# EasyEDA Pro project FPGA-G1.eprj, board logi Pi
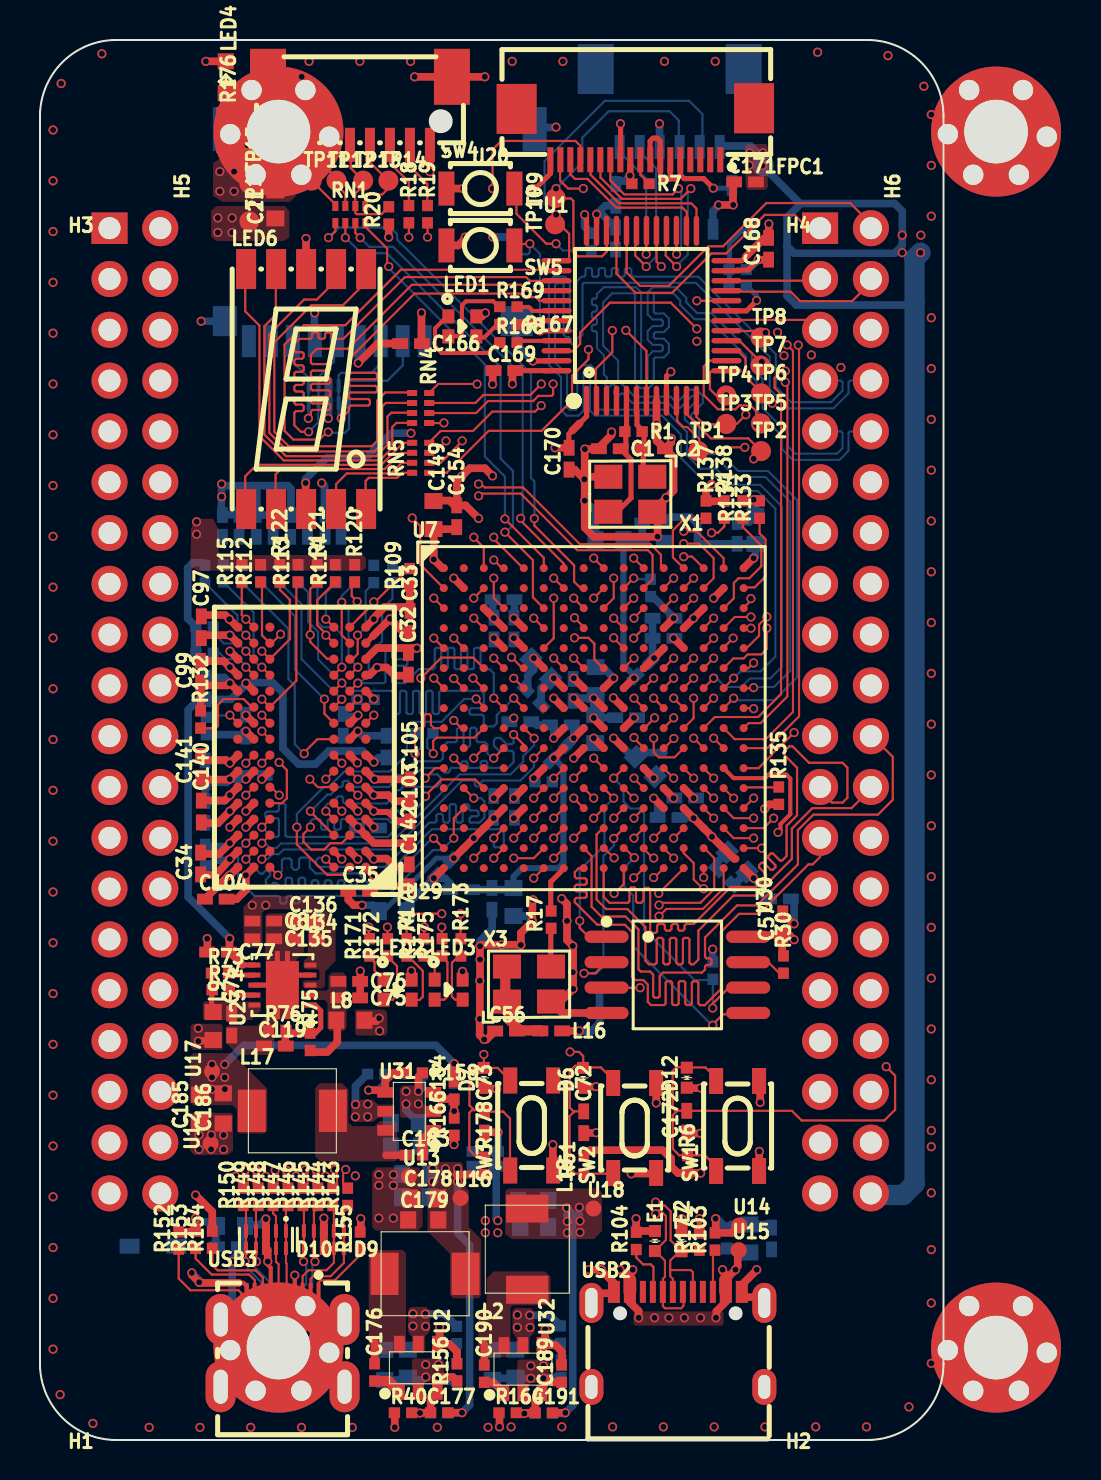
[diagram p10: board, top side]
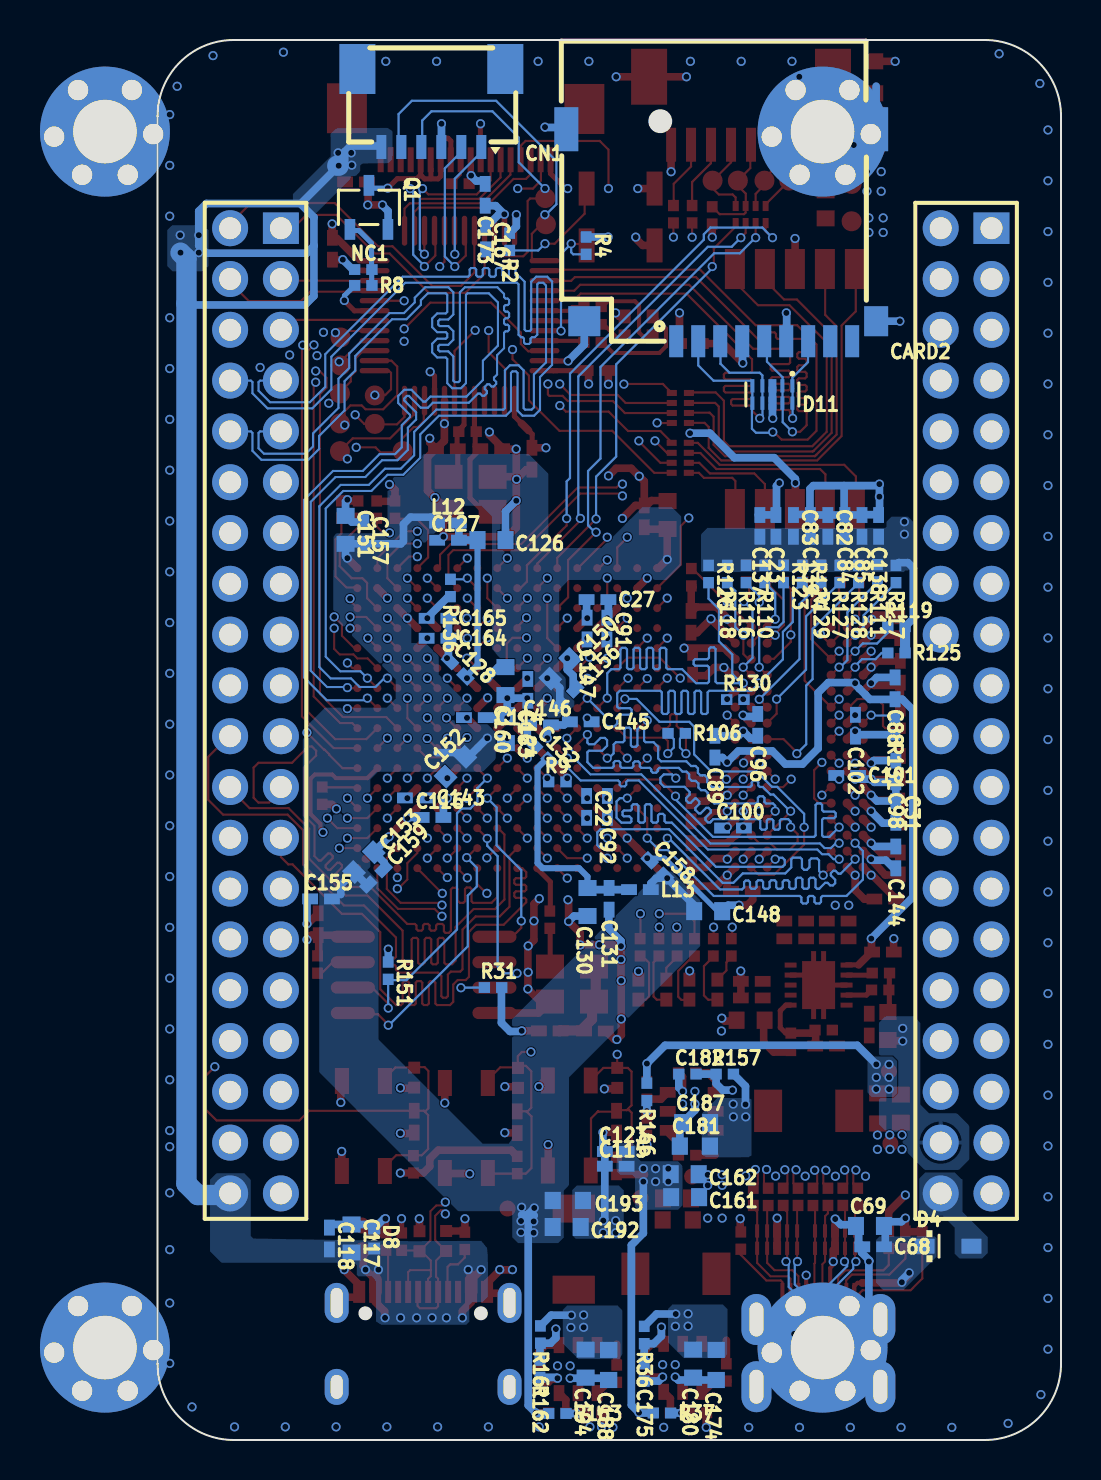
[diagram p11: board, bottom side, seen from below]

Outline 45.2 x 70 mm; copper layers: Top Layer, GND02, SIG03, SIG04, POWER05, Bottom Layer. Coordinates in mm from the lower left corner of the outline.
Outline path: 0,66.19 arc(1.12,68.88) 3.81,70 41.39,70 arc(44.08,68.88) 45.2,66.19 45.2,3.81 arc(44.08,1.12) 41.39,0 3.81,0 arc(1.12,1.12) 0,3.81 0,66.19
Stack: Top Layer 0.035mm 外层铜厚1oz / Dielectric1 0.0994mm 3313 RC57% 4.2mil / GND02 0.0152mm 内层铜厚 / Dielectric2 0.55mm 0.55mm H/H No copper / SIG03 0.0152mm 内层铜厚 / Dielectric3 0.1088mm 2116 RC54% 4.9mil / SIG04 0.0152mm 内层铜厚 / Dielectric4 0.55mm 0.55mm H/H No copper / POWER05 0.0152mm 内层铜厚 / Dielectric5 0.0994mm 3313 RC57% 4.2mil / Bottom Layer 0.035mm 外层铜厚1oz

## Design rules (mm)
net GND: POWER
net +5V_IN: POWER
net +3.3V: POWER
net VTT_DRAM: POWER
net +1.5V: POWER
net HDMI_5V: POWER
net VREF_DRAM: POWER
net VCCPLLL: POWER
net VCCPLLR: POWER
net +1.0V: POWER
net PB4/SPI2_MISO: TF CARD
net PB3/SPI2_SCK: TF CARD
net PB5/SPI2_MOSI: TF CARD
net PA15/SPI2_NSS: TF CARD
net HDMI_DATA2_P: HDMI_DATA2_
net HDMI_DATA2_N: HDMI_DATA2_
net HDMI_DATA1_P: HDMI_DATA1_
net HDMI_DATA1_N: HDMI_DATA1_
net HDMI_DATA0_P: HDMI_DATA0_
net HDMI_DATA0_N: HDMI_DATA0_
net HDMI_CLK_P: HDMI_CLK_
net HDMI_CLK_N: HDMI_CLK_
net M15_IOT40B: USB
net M14_IOT40A: USB
net EX_IOT24B_K16: BANK0, FPGA_IOT24
net EX_IOT24A_J15: BANK0, FPGA_IOT24
net EX_IOT22B_J14: BANK0, FPGA_IOT22
net EX_IOT22A_J16: BANK0, FPGA_IOT22
net EX_IOT9A_F14: BANK0, FPGA_IOT9
net EX_IOT9B_F16: BANK0, FPGA_IOT9
net EX_IOT27B_J13: BANK0, FPGA_IOT27
net EX_IOT27A_H11: BANK0, FPGA_IOT27
net EX_IOT6A_E16: BANK0, FPGA_IOT6
net EX_IOT6B_F15: BANK0, FPGA_IOT6
net EX_IOT5A_C16: BANK0, FPGA_IOT5
net EX_IOT5B_D15: BANK0, FPGA_IOT5
net EX_IOT4A_D16: BANK0, FPGA_IOT4
net EX_IOT4B_E14: BANK0, FPGA_IOT4
net EX_IOL8A_B13: BANK7, FPGA_IOL8
net EX_IOL8B_A14: BANK7, FPGA_IOL8
net EX_IOL2A_B14: BANK7, FPGA_IOT2
net EX_IOL2B_A15: BANK7, FPGA_IOT2
net EX_IOL13B_A12: BANK7, FPGA_IOL13
net EX_IOL13A_B11: BANK7, FPGA_IOL13
net EX_IOL7B_B12: BANK7, FPGA_IOL7
net EX_IOL7A_C12: BANK7, FPGA_IOL7
net EX_IOL15B_C11: BANK7, FPGA_IOL15
net EX_IOL15A_A11: BANK7, FPGA_IOL15
net EX_IOL27B_C9: BANK7, FPGA_IOL27
net EX_IOL27A_A9: BANK7, FPGA_IOL27
net EX_IOL17B_E10: BANK7, FPGA_IOL17
net EX_IOL17A_D10: BANK7, FPGA_IOL17
net EX_IOR27A_N10: BANK2, FPGA_IOR27
net EX_IOR27B_M11: BANK2, FPGA_IOR27
net EX_IOR8A_P12: BANK2, FPGA_IOR8
net EX_IOR24B_P11: BANK2, FPGA_IOR24
net EX_IOR8B_T13: BANK2, FPGA_IOR8
net EX_IOR24A_T11: BANK2, FPGA_IOR24
net EX_IOR7B_R14: BANK2, FPGA_IOR7
net EX_IOR7A_T15: BANK2, FPGA_IOR7
net EX_IOT13A_G15: BANK0, FPGA_IOT13
net EX_IOT13B_G14: BANK0, FPGA_IOT13
net EX_IOT16A_G16: BANK0, FPGA_IOT16
net EX_IOT16B_H15: BANK0, FPGA_IOT16
net EX_IOR40B_L9: BANK3
net EX_IOR44B_L8: BANK3
net EX_IOR36B_N9: BANK3
net EX_IOR44A_M6: BANK3
net EX_IOR36A_M8: BANK3
net EX_IOR47A_M7: BANK3
net EX_IOR53B_T6: BANK3
net EX_IOR47B_N7: BANK3
net EX_IOR40A_N8: BANK3
net EX_IOR53A_P6: BANK3
net EX_IOR29B_R8: BANK3
net EX_IOR38A_T9: BANK3
net EX_IOR38B_P9: BANK3
net EX_IOR42B_T8: BANK3
net EX_IOR42A_P8: BANK3
net EX_IOT30A_K14: BANK1, FPGA_IOT30
net EX_IOT30B_K15: BANK1, FPGA_IOT30
net EX_IOT36A_K13: BANK1, FPGA_IOT36
net EX_IOT36B_K12: BANK1, FPGA_IOT36
net EX_IOT48A_N15: BANK1, FPGA_IOT48
net EX_IOT48B_P16: BANK1, FPGA_IOT48
net EX_IOT54A_P15: BANK1, FPGA_IOT54
net EX_IOT54B_R16: BANK1, FPGA_IOT54
net EX_IOT52A_N16: BANK1, FPGA_IOT52
net EX_IOT52B_N14: BANK1, FPGA_IOT52
net DDR3_CKN: ADDR, DDR3_CK
net DDR3_CKP: ADDR, DDR3_CK
net DDR3_RSTN: ADDR
net DDR3_A13: ADDR
net DDR3_A12: ADDR
net DDR3_A11: ADDR
net DDR3_A10: ADDR
net DDR3_A9: ADDR
net DDR3_A8: ADDR
net DDR3_A7: ADDR
net DDR3_A6: ADDR
net DDR3_A5: ADDR
net DDR3_A4: ADDR
net DDR3_A3: ADDR
net DDR3_A2: ADDR
net DDR3_A1: ADDR
net DDR3_A0: ADDR
net DDR3_BA2: ADDR
net DDR3_BA1: ADDR
net DDR3_BA0: ADDR
net DDR3_CASN: ADDR
net DDR3_RASN: ADDR
net DDR3_WEN: ADDR
net DDR3_CSN: ADDR
net DDR3_CK_EN: ADDR
net LVDS_IOR11_P: LVDS_IOR11_
net LVDS_IOR11_N: LVDS_IOR11_
net LVDS_IOR17_P: LVDS_IOR17_
net LVDS_IOR17_N: LVDS_IOR17_
net LVDS_IOR20_P: LVDS_IOR20_
net LVDS_IOR20_N: LVDS_IOR20_
net LVDS_IOR22_P: LVDS_IOR22_
net LVDS_IOR22_N: LVDS_IOR22_
net DDR3_DQ5: D0-7
net DDR3_DQ6: D0-7
net DDR3_LDM: D0-7
net DDR3_DQ11: D8-15
net DDR3_DQ14: D8-15
net DDR3_DQ4: D0-7
net DDR3_LDQSP: D0-7, DDR3_LDQS
net DDR3_DQ15: D8-15
net DDR3_DQ10: D8-15
net DDR3_DQ7: D0-7
net DDR3_DQ3: D0-7
net DDR3_LDQSN: D0-7, DDR3_LDQS
net DDR3_DQ13: D8-15
net DDR3_DQ8: D8-15
net DDR3_ODT: ADDR
net DDR3_DQ2: D0-7
net DDR3_DQ9: D8-15
net DDR3_DQ12: D8-15
net DDR3_DQ1: D0-7
net DDR3_DQ0: D0-7
net DDR3_UDQSP: D8-15, DDR3_UDQS
net DDR3_UDM: D8-15
net DDR3_UDQSN: D8-15, DDR3_UDQS
template: 自定义配置
spacing copperThickness1oz (default): track to track 0.102, other pairs 0.102 to 0.381
spacing copperThickness2oz: track to track 0.203, other pairs 0.152 to 0.3
spacing 3W: track to track 0.218, other pairs 0.102 to 0.3
spacing TF: track to track 0.152, other pairs 0 to 0.3
track width copperThickness2oz: min 0.203, default 0.254, max 2.54
track width 50ohm (default): min 0.109, default 0.109, max 2.54
track width POWER: min 0.127, default 0.381, max 2.54
differential pair differentialPair: width min 0.127, default 0.254, max 2.54; gap min 0.152, default 0.152
differential pair 90ohm: width min 0.102, default 0.102, max 0.102; gap min 0.135, default 0.135
differential pair 100ohm (default): width min 0.104, default 0.104, max 0.104; gap min 0.201, default 0.201
differential pair 100OHM-BGA: width min 0.102, default 0.102, max 2.54; gap min 0.102, default 0.102
via viaSize (default): diameter min 0.457, default 0.457, max 0.457; hole min 0.305, default 0.305, max 0.305
net class POWER uses POWER
net class ADDR uses 3W
net class D0-7 uses 3W
net class D8-15 uses 3W
net class TF CARD uses 3W
net GND uses POWER
net +5V_IN uses POWER
net +3.3V uses POWER
net VTT_DRAM uses POWER
net +1.5V uses POWER
net HDMI_5V uses POWER
net VREF_DRAM uses POWER
net VCCPLLL uses POWER
net VCCPLLR uses POWER
net +1.0V uses POWER
net PB4/SPI2_MISO uses 3W
net PB3/SPI2_SCK uses 3W
net PB5/SPI2_MOSI uses 3W
net PA15/SPI2_NSS uses 3W
net M15_IOT40B uses 90ohm
net M14_IOT40A uses 90ohm
net DDR3_CKN uses 3W
net DDR3_CKP uses 3W
net DDR3_RSTN uses 3W
net DDR3_A13 uses 3W
net DDR3_A12 uses 3W
net DDR3_A11 uses 3W
net DDR3_A10 uses 3W
net DDR3_A9 uses 3W
net DDR3_A8 uses 3W
net DDR3_A7 uses 3W
net DDR3_A6 uses 3W
net DDR3_A5 uses 3W
net DDR3_A4 uses 3W
net DDR3_A3 uses 3W
net DDR3_A2 uses 3W
net DDR3_A1 uses 3W
net DDR3_A0 uses 3W
net DDR3_BA2 uses 3W
net DDR3_BA1 uses 3W
net DDR3_BA0 uses 3W
net DDR3_CASN uses 3W
net DDR3_RASN uses 3W
net DDR3_WEN uses 3W
net DDR3_CSN uses 3W
net DDR3_CK_EN uses 3W
net LVDS_IOR11_P uses LVDS
net LVDS_IOR11_N uses LVDS
net LVDS_IOR17_P uses LVDS
net LVDS_IOR17_N uses LVDS
net LVDS_IOR20_P uses LVDS
net LVDS_IOR20_N uses LVDS
net LVDS_IOR22_P uses LVDS
net LVDS_IOR22_N uses LVDS
net DDR3_DQ5 uses 3W, D0-D7
net DDR3_DQ6 uses 3W, D0-D7
net DDR3_LDM uses 3W, D0-D7
net DDR3_DQ11 uses 3W, D8-D15
net DDR3_DQ14 uses 3W, D8-D15
net DDR3_DQ4 uses 3W, D0-D7
net DDR3_LDQSP uses 3W, D0-D7
net DDR3_DQ15 uses 3W, D8-D15
net DDR3_DQ10 uses 3W, D8-D15
net DDR3_DQ7 uses 3W, D0-D7
net DDR3_DQ3 uses 3W, D0-D7
net DDR3_LDQSN uses 3W, D0-D7
net DDR3_DQ13 uses 3W, D8-D15
net DDR3_DQ8 uses 3W, D8-D15
net DDR3_ODT uses 3W
net DDR3_DQ2 uses 3W, D0-D7
net DDR3_DQ9 uses 3W, D8-D15
net DDR3_DQ12 uses 3W, D8-D15
net DDR3_DQ1 uses 3W, D0-D7
net DDR3_DQ0 uses 3W, D0-D7
net DDR3_UDQSP uses 3W, D8-D15
net DDR3_UDM uses 3W, D8-D15
net DDR3_UDQSN uses 3W, D8-D15
diff pair USB uses 90ohm
eq len grp LVDS uses LVDS
eq len grp D0-D8 uses D0-D7
eq len grp D8-D15 uses D8-D15
region e5288 uses 100OHM-BGA
region e5586 uses 100OHM-BGA
region e5871 uses TF
region e5875 uses TF
region e5876 uses TF

## Placement (name value [footprint] x y rotation side)
C1  18pF  [C0402]  28.51 49.56 180 top
C2  18pF  [C0402]  30.72 49.56 180 top
C21  22uF  [C0603]  11.77 61.78 90 top
C22  100nF  [C0402]  23.73 31.66 270 bottom
C23  100nF  [C0402]  14.26 45.7 90 bottom
C27  100nF  [C0402]  23.19 42.02 0 bottom
C31  100nF  [C0402]  8.26 31.41 270 bottom
C32  100nF  [C0402]  18.43 38.81 270 top
C33  100nF  [C0402]  18.51 40.91 270 top
C34  100nF  [C0402]  8.04 28.82 90 top
C35  100nF  [C0402]  15.97 27.44 0 top
C56  100nF  [C0402]  23.32 20.45 0 top
C57  100nF  [C0402]  37.16 25.79 90 top
C68  100nF  [C0402]  9.4 9.66 0 bottom
C69  10uF  [C0603]  9.56 10.7 180 bottom
C72  100nF  [C0402]  27.2 15.89 270 top
C73  100nF  [C0402]  22.24 15.92 270 top
C74  2.2uF  [C0402]  9.59 20.77 270 top
C75  10uF  [C0402]  15.47 22.11 180 top
C76  10uF  [C0402]  15.47 22.93 180 top
C77  100nF  [C0402]  8.91 24.4 180 top
C81  2.2uF  [C0402]  11.17 25.95 180 top
C82  2.2uF  [C0402]  11.66 45.7 270 bottom
C83  2.2uF  [C0402]  13.39 45.7 270 bottom
C84  100nF  [C0402]  10.82 45.7 90 bottom
C85  100nF  [C0402]  9.96 45.7 90 bottom
C88  100nF  [C0402]  8.3 37.58 90 bottom
C89  100nF  [C0402]  17.31 34.67 90 bottom
C91  100nF  [C0402]  22.72 40.57 270 bottom
C92  100nF  [C0402]  22.69 31.66 90 bottom
C96  2.2uF  [C0402]  15.17 35.76 90 bottom
C97  2.2uF  [C0402]  8.07 40.64 270 top
C98  2.2uF  [C0402]  8.26 33.43 90 bottom
C99  2.2uF  [C0402]  8.04 38.41 90 top
C100  100nF  [C0402]  16.41 30.6 180 bottom
C101  100nF  [C0402]  10.7 33.23 0 bottom
C102  100nF  [C0402]  10.28 35.71 90 bottom
C103  100nF  [C0402]  18.51 30.39 270 top
C104  100nF  [C0402]  8.79 27.04 0 top
C105  100nF  [C0402]  18.51 32.49 270 top
C114  100nF  [C0402]  29.33 36.12 0 bottom
C115  100nF  [C0402]  22.28 13.69 180 bottom
C116  100nF  [C0402]  31.44 31.13 180 bottom
C117  22uF  [C0603]  35.49 10.08 270 bottom
C118  100nF  [C0402]  36.6 10.08 270 bottom
C119  1nF  [C0402]  11.75 19.7 0 top
C123  100nF  [C0402]  22.28 14.42 180 bottom
C124  100nF  [C0402]  26.67 37.51 90 bottom
C126  10uF  [C0603]  28.49 45 0 bottom
C127  1nF  [C0402]  30.67 44.99 180 bottom
C128  100nF  [C0402]  30.18 38.56 225 bottom
C130  10uF  [C0603]  23.69 26.9 90 bottom
C131  1nF  [C0402]  22.61 27.06 90 bottom
C132  100nF  [C0402]  25.97 34.36 225 bottom
C134  10uF  [C0402]  13.3 25.06 0 top
C135  10uF  [C0402]  11.17 25.06 180 top
C136  10uF  [C0402]  13.3 25.95 0 top
C137  100nF  [C0402]  15.07 45.7 90 bottom
C138  100nF  [C0402]  9.13 45.7 90 bottom
C139  100nF  [C0402]  12.54 45.7 90 bottom
C140  100nF  [C0402]  8.07 31.42 270 top
C141  100nF  [C0402]  8.04 33.66 90 top
C142  100nF  [C0402]  18.47 28.23 270 top
C143  100nF  [C0402]  32.28 32.1 0 bottom
C144  100nF  [C0402]  8.27 29.13 90 bottom
C145  100nF  [C0402]  24.03 35.91 0 bottom
C146  100nF  [C0402]  26.06 35.75 180 bottom
C147  100nF  [C0402]  23.71 40.57 90 bottom
C148  22uF  [C0603]  17.65 26.44 0 bottom
C149  22uF  [C0603]  19.68 46.25 270 top
C150  22uF  [C0603]  25.05 38.56 315 bottom
C151  10uF  [C0603]  35.79 45.51 270 bottom
C152  10uF  [C0603]  30.29 33.67 135 bottom
C153  10uF  [C0603]  34.88 28.9 315 bottom
C154  100nF  [C0402]  20.85 46.19 270 top
C155  100nF  [C0402]  37.02 27.05 180 bottom
C156  100nF  [C0402]  24.69 37.15 315 bottom
C157  100nF  [C0402]  34.88 45.35 270 bottom
C158  100nF  [C0402]  20.19 28.6 225 bottom
C159  100nF  [C0402]  34.27 28.16 315 bottom
C160  22uF  [C0603]  27.79 37.95 90 bottom
C161  22uF  [C0603]  18.81 12.14 0 bottom
C162  10uF  [C0603]  18.82 13.29 0 bottom
C163  10uF  [C0603]  27.77 35.54 270 bottom
C164  100nF  [C0402]  31.19 40.09 0 bottom
C165  100nF  [C0402]  31.19 41.09 0 bottom
C166  100nF  [C0402]  18.56 54.82 180 top
C167  100nF  [C0402]  28.79 60.07 270 bottom
C168  100nF  [C0402]  36.45 59.56 90 top
C169  100nF  [C0402]  23.23 53.47 0 top
C170  100nF  [C0402]  26.47 49.07 90 top
C171  100nF  [C0402]  35.27 62.9 0 top
C172  100nF  [C0402]  32.36 15.91 90 top
C173  100nF  [C0402]  28.81 62.26 90 bottom
C174  100nF  [R0603]  17.25 3.75 90 bottom
C175  100nF  [R0402]  20.85 3.38 90 bottom
C176  100nF  [R0402]  16.74 3.38 270 top
C177  22pF  [R0402]  19.97 1.37 0 top
C178  22uF  [C0603]  19.21 12.08 0 top
C179  100nF  [R0603]  19.17 11 0 top
C180  10uF  [C0603]  18.41 3.82 90 bottom
C181  100nF  [R0603]  18.32 14.69 180 bottom
C182  100nF  [R0402]  18.69 18.29 180 bottom
C183  100nF  [R0402]  18.7 14.24 0 top
C184  22pF  [R0402]  20.72 17.48 90 top
C185  22uF  [C0603]  8.01 16.57 90 top
C186  100nF  [R0603]  9.17 16.58 90 top
C187  10uF  [C0603]  18.25 15.85 180 bottom
C188  100nF  [R0603]  22.63 3.75 90 bottom
C189  100nF  [R0402]  26.09 3.31 90 top
C190  100nF  [R0402]  22.23 3.31 270 top
C191  22pF  [R0402]  25.21 1.36 0 top
C192  22uF  [C0603]  24.73 10.65 0 bottom
C193  100nF  [R0603]  24.67 11.98 0 bottom
C194  10uF  [C0603]  23.78 3.82 90 bottom
CARD2  TF PUSH  [TF-SMD_TF-PUSH]  17 60.24 0 bottom
CN1  WAFER-100W-6A  [CONN-SMD_6P-P1.00_XUNPU_WAFER-100W-6P]  31.5 66.6 0 bottom
D4  1N5819WS  [SOD-323_L1.8-W1.3-LS2.5-RD]  5.65 9.69 180 bottom
D6  0402ESDA-05N  [D0402-BI]  27.17 18.1 90 top
D7  0402ESDA-05N  [D0402-BI]  22.2 18.1 90 top
D8  0402ESDA-05N  [D0402-BI]  34.36 10.08 270 bottom
D9  RCLAMP0524P  [DFN2510-10_L2.5-W1.0-P0.50-BL]  14.2 10.02 180 top
D10  RCLAMP0524P  [DFN2510-10_L2.5-W1.0-P0.50-BL]  11.31 10.02 180 top
D11  RCLAMP0524P  [DFN2510-10_L2.5-W1.0-P0.50-BL]  14.44 52.28 0 bottom
D12  0402ESDA-05N  [D0402-BI]  32.36 18.12 90 top
E1  0402ESDA-05N  [D0402-BI]  30.76 9.95 270 top
E2  0402ESDA-05N  [D0402-BI]  32.09 9.94 270 top
FPC1  FPC-05F-18PH20  [FPC-SMD_18P-P0.50_FPC-05F-18PH20]  29.78 65.3 180 top
H1  -  [125 X 300]  4.57 4.62 0 top
H2  -  [125 X 300]  40.47 4.62 0 top
H3  -  [125 X 300]  4.57 65.42 0 top
H4  -  [125 X 300]  40.47 65.42 0 top
H5  12251220ANG0S115001  [HDR-TH_40P-P2.54-V-M-R2-C20-S2.54]  4.75 36.46 270 top
H6  12251220ANG0S115001  [HDR-TH_40P-P2.54-V-M-R2-C20-S2.54]  40.3 36.46 270 top
L2  3.3uH  [IND-SMD_L4.4-W4.2]  19.27 8.31 180 top
L8  MPZ1608S101ATAH0  [L0603]  15.53 20.99 0 top
L9  MPZ1608S101ATAH0  [L0603]  8.66 20.7 270 top
L12  UPZ1005D121-1R3TF  [L0402]  30.67 45.84 180 bottom
L13  UPZ1005D121-1R3TF  [L0402]  21.07 27.52 0 bottom
L16  UPZ1005D121-1R3TF  [L0402]  25.58 20.46 180 top
L17  3.3uH  [IND-SMD_L4.4-W4.2]  12.62 16.46 0 top
L18  3.3uH  [IND-SMD_L4.4-W4.2]  24.38 9.54 270 top
LED1  E6C0606RGBC3UDA  [LED-SMD_4P-L1.6-W1.6-TL-FD]  21.13 55.68 0 top
LED2  E6C0606RGBC3UDA  [LED-SMD_4P-L1.6-W1.6-TL-FD]  17.89 22.52 0 top
LED3  E6C0606RGBC3UDA  [LED-SMD_4P-L1.6-W1.6-TL-FD]  20.44 22.52 0 top
LED4  F.0603.00139/P2-0603R1TS2-06T-002  [LED0603-RD]  9.29 68.13 270 top
LED6  SLS0281FR1A1GD  [LED-SEG-SMD_SLS0281FR1A1GD]  13.31 52.55 0 top
NC1  10kΩ  [R0402]  34.91 58.52 180 bottom
Q1  S8050 J3Y  [SOT-23-3_L3.0-W1.7-P0.95-LS2.9-BR]  34.62 61.63 270 bottom
R1  1MΩ  [R0402]  29.69 50.42 180 top
R2  10kΩ  [R0402]  27.58 59.91 90 bottom
R4  10kΩ  [R0402]  23.75 59.72 270 bottom
R6  10kΩ  [R0402]  32.4 13.78 270 top
R7  10Ω  [R0402]  30.04 62.81 180 top
R8  1kΩ  [R0402]  34.91 57.73 0 bottom
R9  10kΩ  [R0402]  25.2 32.9 180 bottom
R17  22Ω  [R0402]  25.57 26.02 90 top
R18  33Ω  [R0402]  18.45 61.29 270 top
R19  33Ω  [R0402]  19.39 61.29 270 top
R20  4.7kΩ  [R0402]  17.45 61.23 90 top
R30  4.7kΩ  [R0402]  37.2 23.77 270 top
R31  4.7kΩ  [R0402]  28.41 22.62 180 bottom
R36  47kΩ  [R0402]  20.85 5.25 90 bottom
R37  15kΩ  [R0402]  19.96 1.35 0 bottom
R40  3.3kΩ  [R0402]  18.16 1.36 0 top
R61  10kΩ  [R0402]  27.2 13.75 90 top
R73  0Ω  [R0402]  9.01 23.35 0 top
R74  100kΩ  [R0402]  9.05 22.5 0 top
R75  10kΩ  [R0402]  13.52 19.91 270 top
R76  10kΩ  [R0402]  11.87 20.49 0 top
R103  5.1kΩ  [R0402]  33.77 9.92 90 top
R104  5.1kΩ  [R0402]  29.83 9.96 90 top
R106  100Ω  [R0402]  19.23 35.33 0 bottom
R109  1kΩ  [R0402]  18.49 43.14 90 top
R110  49.9Ω  [R0402]  14.82 43.3 90 bottom
R111  49.9Ω  [R0402]  9.18 43.34 90 bottom
R112  49.9Ω  [R0402]  11.03 43.34 90 top
R113  49.9Ω  [R0402]  12.9 43.34 90 top
R114  49.9Ω  [R0402]  14.77 43.34 90 top
R115  49.9Ω  [R0402]  10.1 43.34 90 top
R116  49.9Ω  [R0402]  15.76 43.3 90 bottom
R117  49.9Ω  [R0402]  8.26 43.3 90 bottom
R118  49.9Ω  [R0402]  16.7 43.3 90 bottom
R119  49.9Ω  [R0402]  8.23 40.66 180 bottom
R120  49.9Ω  [R0402]  15.74 43.34 270 top
R121  49.9Ω  [R0402]  13.87 43.34 270 top
R122  49.9Ω  [R0402]  12 43.34 270 top
R123  49.9Ω  [R0402]  13.88 43.3 270 bottom
R124  49.9Ω  [R0402]  12.94 43.3 270 bottom
R125  49.9Ω  [R0402]  8.23 39.35 0 bottom
R126  49.9Ω  [R0402]  17.63 43.3 270 bottom
R127  49.9Ω  [R0402]  11.07 43.3 90 bottom
R128  49.9Ω  [R0402]  10.13 43.3 90 bottom
R129  49.9Ω  [R0402]  12.01 43.3 90 bottom
R130  1kΩ  [R0402]  16.29 37.02 180 bottom
R131  1kΩ  [R0402]  8.31 35.7 90 bottom
R132  240Ω  [R0402]  8.04 36.02 270 top
R133  4.7kΩ  [R0402]  36 46.52 90 top
R134  4.7kΩ  [R0402]  35.16 46.52 90 top
R135  4.7kΩ  [R0402]  36.96 32.21 270 top
R136  4.7kΩ  [R0402]  30.55 42.6 90 bottom
R137  4.7kΩ  [R0402]  33.32 46.52 270 top
R138  4.7kΩ  [R0402]  34.24 46.52 270 top
R143  0Ω  [R0402]  15.39 12.16 90 top
R144  0Ω  [R0402]  14.65 12.16 90 top
R145  0Ω  [R0402]  13.9 12.16 90 top
R146  0Ω  [R0402]  13.16 12.16 90 top
R147  0Ω  [R0402]  12.41 12.16 90 top
R148  0Ω  [R0402]  11.66 12.16 90 top
R149  0Ω  [R0402]  10.92 12.16 90 top
R150  0Ω  [R0402]  10.17 12.16 90 top
R151  1kΩ  [R0402]  33.66 23.47 270 bottom
R152  10kΩ  [R0402]  6.94 9.98 90 top
R153  10kΩ  [R0402]  7.79 10.01 90 top
R154  10kΩ  [R0402]  8.62 10.01 90 top
R155  10kΩ  [R0402]  16.02 9.97 90 top
R156  30kΩ  [R0402]  20.86 3.38 90 top
R157  47kΩ  [R0402]  16.82 18.29 180 bottom
R158  30kΩ  [R0402]  18.7 18.36 180 top
R161  47kΩ  [R0402]  26.05 5.27 90 bottom
R162  30kΩ  [R0402]  26.07 3.56 90 bottom
R163  12kΩ  [R0402]  25.2 1.32 0 bottom
R164  18kΩ  [R0402]  23.4 1.36 0 top
R165  12kΩ  [R0402]  20.72 15.67 90 top
R166  18kΩ  [R0402]  20.72 17.41 90 bottom
R167  3kΩ  [R0402]  23.44 55.78 180 top
R168  4.3kΩ  [R0402]  23.44 54.87 0 top
R169  9.1kΩ  [R0402]  23.44 56.66 0 top
R170  3kΩ  [R0402]  18.34 24.63 270 top
R171  4.3kΩ  [R0402]  16.49 24.63 90 top
R172  9.1kΩ  [R0402]  17.4 24.63 90 top
R173  3kΩ  [R0402]  21.06 24.63 270 top
R174  4.3kΩ  [R0402]  19.21 24.63 90 top
R175  9.1kΩ  [R0402]  20.12 24.63 90 top
R176  4.7kΩ  [R0603]  9.25 65.5 270 top
R177  1.5kΩ  [R0402]  32.99 9.92 90 top
R178  10kΩ  [R0402]  22.24 13.71 270 top
RN1  33Ω  [RES-ARRAY-SMD_0402-8P-L2.0-W1.0-BL]  15.53 61.27 0 top
RN4  510Ω  [RES-ARRAY-SMD_0402-8P-L2.0-W1.0-BL]  19.04 51.6 270 top
RN5  510Ω  [RES-ARRAY-SMD_0402-8P-L2.0-W1.0-BL]  19.05 49.11 90 top
SW1  PTS815SJK250SMTRLFS  [SW-SMD_4P-L4.2-W3.3-P2.15-LS5.1]  34.9 15.7 90 top
SW2  PTS815SJK250SMTRLFS  [SW-SMD_4P-L4.2-W3.3-P2.15-LS5.1]  29.75 15.6 90 top
SW3  PTS815SJK250SMTRLFS  [SW-SMD_4P-L4.2-W3.3-P2.15-LS5.1]  24.6 15.72 90 top
SW4  B3U-1000P  [KEY-SMD_B3U-1000PM]  22.03 62.57 0 top
SW5  B3U-1000P  [KEY-SMD_B3U-1000PM]  22.03 59.73 180 top
TP1  -  [Test-Point-0.5mm]  32.93 49.44 0 top
TP2  -  [Test-Point-0.5mm]  36.07 49.44 0 top
TP3  -  [Test-Point-0.5mm]  34.33 50.8 0 top
TP4  -  [Test-Point-0.5mm]  34.33 52.23 0 top
TP5  -  [Test-Point-0.5mm]  36.07 50.83 0 top
TP6  -  [Test-Point-0.5mm]  36.07 52.33 0 top
TP7  -  [Test-Point-0.5mm]  36.04 53.73 0 top
TP8  -  [Test-Point-0.5mm]  36.04 55.13 0 top
TP9  -  [Test-Point-0.5mm]  25.8 62.1 90 top
TP10  -  [Test-Point-0.5mm]  25.77 60.79 90 top
TP11  -  [Test-Point-0.5mm]  13.59 62.97 0 top
TP12  -  [Test-Point-0.5mm]  14.84 62.97 0 top
TP13  -  [Test-Point-0.5mm]  16.17 62.97 0 top
TP14  -  [Test-Point-0.5mm]  17.43 62.97 0 top
TP15  -  [Test-Point-0.5mm]  10.48 62.8 270 top
TP16  -  [Test-Point-0.5mm]  10.48 60.94 270 top
U1  GD32F303CBT6  [LQFP-48_L7.0-W7.0-P0.50-LS9.0-BL]  30.09 56.21 0 top
U2  SY8113BADC  [TSOT-23-6_L2.9-W1.6-P0.95-LS2.8-BR]  18.93 3.61 270 top
U7  -  [FBGA-256_L17.0-W17.0-R16-C16-P1.00-TL-1]  27.7 36.09 0 top
U12  -  [测试点0.8mm]  8.54 14.82 90 top
U13  -  [测试点0.8mm]  18.46 13.17 0 top
U14  -  [测试点0.8mm]  34.98 10.73 0 top
U15  -  [测试点0.8mm]  34.95 9.49 0 top
U16  -  [测试点0.8mm]  21.04 12.1 0 top
U17  -  [测试点0.8mm]  8.61 18.43 90 top
U18  -  [测试点0.8mm]  27.69 11.57 0 top
U20  ZX-SH1.0-8PWT  [CONN-SMD_8P-P1.00_MEGASTAR_ZX-SH1.0-8PWT]  16.01 66.46 180 top
U23  TPS51200DRCR  [WSON-10_L3.0-W3.0-P0.50-BL-EP]  12.13 22.75 90 top
U29  MT41J128M16JT-125-K  [FBGA-96_L14.0-W9.0-R16-C6-P0.80-TL]  13.1 34.64 180 top
U30  W25Q64JVSSIQ  [SOP-8_L5.3-W5.3-P1.27-LS8.0-BL]  31.89 23.26 270 top
U31  SY8113BADC  [TSOT-23-6_L2.9-W1.6-P0.95-LS2.8-BR]  18.47 16.43 0 top
U32  SY8113BADC  [TSOT-23-6_L2.9-W1.6-P0.95-LS2.8-BR]  24.16 3.54 270 top
USB2  TYPE-C 16PIN 2MD(073)  [USB-C-SMD_TYPE-C-6PIN-2MD-073]  31.91 5.03 0 top
USB3  -  [hdmi-smd_hdmi-101s]  12.14 5.05 0 top
X1  8MHz  [OSC-SMD_4P-L3.2-W2.5-BL]  29.53 47.29 180 top